# EAGLE board MCS (EAGLE 6.6.0) (continued)
## Tracks (layer width: path | path; a pad name or v marks a point on that pad's centre or on a via) (continued)
  pour Top: 63.27,23.88 62.41,23.88 62.36,23.93 62.36,24.66 62.46,24.77 63.22,24.77 63.27,24.71
+9V  (via drill 0.6)
  Top 0.406: R43.2 87.43,44.58 v87.83,44.98 | v73.74,52.63 73.74,52.07 73.23,51.56
  Top 1.016: C7.A 69.29,44.81 71.58,47.09 71.58,51.21 72.11,51.74 73.05,51.74 73.23,51.56
  Bottom 0.406: v87.83,44.98 87,44.98 86.59,45.39 74.73,45.39 73.89,46.23 73.89,52.48 v73.74,52.63
  pour Top: 72.26,58.45 72.26,51.21 76.71,51.18 76.71,58.8 72.9,58.8
  pour Top: 73.89,76.73 71.98,76.71 71.5,76.23 71.5,59.11 72.03,58.57 72.85,58.57 73.13,58.85 73.13,64.14 74.37,65.38 74.35,76.05
+12V
  Top 1.93: CASE2.30 52.48,84.05 U5.6
  Bottom 1.016: U5.5 53.77,79.45 C34.1 53.8,82.72 U5.6
+24V  (via drill 0.6)
  Top 0.305: v83.31,75.82 U8.EP
  Top 0.813: U5.2 53.82,60.48 53.82,59.16 52.73,58.06 37.52,58.06 35.92,59.66 K1.1
  Top 1.27: U5.2 55.32,60.53 58.42,63.63 58.42,97.41 62.74,101.73 97.66,101.73 99.44,99.95 99.44,95.63 98.43,94.61 96.7,94.61 CASE2.47
  Bottom 0.305: 22.96,68.22 22.96,69.95 23.11,70.1
  Bottom 0.813: D4.C 22.43,67.69 22.96,68.22 22.96,70.08 K3.1 | 23.11,70.1 24.89,70.1 25.91,71.12 25.91,73.41 27.05,74.55 37.34,74.55 38.1,73.79 38.1,64.9 37.59,64.39 37.59,60.83 37.21,60.45 36.14,60.45 K1.1
  Bottom 1.016: C33.1 51.21,60.58 U5.2
  Bottom 1.676: C35.1 54.08,60.83 U5.2
  other vias: 80.26,78.11 81.79,78.11 83.31,78.11 84.84,78.11 86.36,78.11 81.03,76.96 82.55,76.96 84.07,76.96 85.6,76.96 80.26,75.82 81.79,75.82 84.84,75.82 86.36,75.82 81.03,74.68 82.55,74.68 84.07,74.68 85.6,74.68 80.26,73.66 81.79,73.66 83.31,73.66 84.84,73.66 86.61,73.66
  pour Bottom: 79.63,77.22 79.63,82.68 81.66,84.71 92.46,84.71 94.23,86.49 94.23,95.5 95.38,96.65 100.46,96.65 100.97,96.14 100.97,84.2 99.06,82.3 96.14,82.3 93.34,79.5 87.88,79.5 87.38,78.99 87.38,73.53 86.87,73.03 80.26,73.03 79.76,73.53 79.76,77.09
-
  Top 1.016: L2.1 71.11,85.96 73.28,88.14 76.84,88.14 79.38,90.68 88.67,90.68 CASE2.42
A  (via drill 0.5, 0.6)
  Top 0.254: U6.11 29.26,77.52 28.78,77.04 28.78,74.35 28.14,73.71 26.29,73.71 25.15,72.57 25.15,60.2 24.64,59.74 24.64,57.63 23.57,56.57 23.57,44.78 25.4,42.95 38.05,42.95 v38.8,42.2 39.95,40.92 39.95,39.86 U1.37 | U1.37 | U8.6 85.34,69.93 84.05,68.63 83.59,68.63 82.85,67.89 82.17,67.89 v81.76,67.49 | v65.41,62.59 63.04,62.59 62.53,62.08 62.53,61.14 60.63,59.23 60.63,44.86 60.66,44.86 60.93,44.58 v61.54,44.58
  Bottom 0.254: v81.76,67.49 81.1,66.83 73.84,66.83 73.48,66.47 73.48,64.64 71.42,62.59 v65.41,62.59 | v61.54,44.58 60.48,44.58 59.06,43.15 39.78,43.15 v38.8,42.2
ASEN  (via drill 0.6)
  Top 0.254: 84.59,65.91 84.59,64.43 84.81,64.21 87.91,64.21 v87.93,64.24 | v60.07,25.93 60.07,34.01 v60.27,34.42 | v55.5,32.84 55.5,34.26 55.22,34.54 54.28,34.54 SJ3.3
  Top 0.305: C16.1 84.59,65.91 R14.2
  Bottom 0.254: v60.07,25.93 60.35,25.65 63.73,25.65 64.85,26.77 64.85,27.28 67.49,29.92 87.5,29.92 88.77,31.19 88.77,51.82 88.87,52.1 88.87,64.03 88.62,64.24 v87.93,64.24 | v60.27,34.42 55.8,34.42 55.37,33.98 55.37,32.97 v55.5,32.84
B  (via drill 0.5, 0.6)
  Top 0.254: U6.10 30.3,76.25 29.29,75.23 29.29,74.09 28.42,73.23 26.52,73.23 25.63,72.34 25.63,59.99 25.17,59.54 25.17,57.4 24.08,56.31 24.08,45.11 25.73,43.46 38.76,43.46 v40.25,41.92 40.64,41.5 40.64,40 U1.36 | U8.5 84.07,69.8 83.67,69.39 82.85,69.39 v82.32,68.86 | v69.75,63.53 69.62,63.45 62.56,63.45 62,62.89 62,61.37 60.15,59.51 60.15,43.76 v60.6,43.31
  Bottom 0.254: v82.32,68.86 81.74,68.86 80.34,67.46 73.25,67.46 73,67.21 73.03,65.56 71.04,63.58 69.85,63.58 v69.75,63.53 | v60.6,43.31 60.02,43.31 59.31,42.6 41.15,42.6 40.36,41.81 v40.25,41.92
BOX_TEMP  (via drill 0.6)
  Top 0.254: R8.1 NTC.2 | NTC.2 C14.1 | NTC.2 63.34,55.2 63.37,55.17 63.37,56.16 v63.78,56.57 | v64.41,50.85 64.39,31.65 63.27,30.53 63.27,27.15 v63.5,26.92 | v41.63,25.81 41.63,28.18 U1.21
  Bottom 0.254: v63.78,56.57 63.78,52.55 64.41,52.02 v64.41,50.85 | v63.5,26.92 42.75,26.92 v41.63,25.81
C  (via drill 0.5, 0.6)
  Top 0.254: U6.9 30.94,74.98 28.68,72.72 26.7,72.72 26.11,72.14 26.11,59.79 25.65,59.31 25.65,57.18 24.61,56.13 24.61,45.36 25.96,44.02 39.42,44.02 41.58,41.86 v41.58,41.35 U1.35 | U8.3 81.53,69.54 81.05,69.06 v80.44,69.06 | v68.76,64.36 61.93,64.36 61.52,63.98 61.52,61.57 59.66,59.72 59.66,42.47 v60.2,41.94
  Bottom 0.254: v80.44,69.06 80.44,68.71 79.73,68 72.87,68 72.39,67.51 72.39,65.73 70.87,64.36 v68.76,64.36 | v60.2,41.94 42.19,41.94 v41.58,41.35
DAC-EN  (via drill 0.5)
  Top 0.254: v39.98,30.91 U1.19 | U1.19
  Bottom 0.254: R2.2 13.1,51.86 12.37,51.13 12.37,47.09 13.39,46.08 21.29,46.08 22.2,45.16 22.2,41.33 24.08,39.45 39.32,39.45 39.93,38.84 39.93,38.43 39.95,31.06 v39.98,30.91
FAN
  Top 0.254: R21.2 78.75,84.34 78.87,84.45 80.39,84.45 80.47,84.54
  Top 2.54: 80.47,84.54 82.42,86.49 94.72,86.49 96.57,88.34 96.6,90.68 CASE2.48
  pour Top (no thermals): 78.49,79.76 82.8,79.76 83.19,80.14 83.19,82.93 84.07,83.82 94.74,83.82 96.27,85.34 96.27,86.61 95,87.88 80.64,87.88 78.49,85.73
FAN-PWM  (via drill 0.5, 0.6)
  Top 0.254: v78.82,68.96 78.82,70.87 U8.1 | v69.77,65.23 61.57,65.23 61.01,64.69 61.01,61.8 59.16,59.94 59.16,41.07 v59.92,40.31 | v37.08,41.55 36.93,41.55 36.78,41.4 U1.41 | U1.41
  Bottom 0.254: v69.77,65.23 70.97,65.23 71.86,66.01 71.86,68.25 72.16,68.55 78.38,68.55 78.82,68.94 78.77,68.91 v78.82,68.96 78.84,68.99 | v59.92,40.31 59.06,41.17 43.38,41.17 42.29,40.08 40.34,40.08 39.4,41.02 37.62,41.02 v37.08,41.55
GND  (via drill 0.5, 0.6)
  Top 0.254: C40.2 66.59,71.82 67.16,72.39 67.16,73.15 67.18,73.18
  Top 0.305: CASE2.9 12.93,90.7 16.92,94.69 16.92,94.97 18.69,96.75 18.9,96.75 20.42,98.27 20.45,98.27 20.83,98.65
  Top 0.406: CASE2.37 68.88,94.72 CASE2.35 64.92,90.73 CASE2.33 65,90.63 65.02,89.81 65.02,86.28 60.88,86.28
  Top 0.61: CASE2.3 4.93,87.66 6.99,85.6 13.59,85.6 | 13.59,85.6 13.84,85.34 | CASE2.15 20.78,90.73 | CASE2.9 12.85,90.73 | CASE2.7 12.85,98.65 | 13.59,85.6 13.59,85.37 13.56,85.34
  Top 0.813: CASE2.5 8.89,94.72 CASE2.7 16.81,94.72 | 16.81,94.72 CASE2.13 | CASE2.11 16.81,94.72 | 12.85,90.73 CASE2.11 | CASE2.11 16.81,94.67 CASE2.15 | 20.83,98.65 23.06,98.65 24.08,97.64 24.1,97.64 24.38,97.36 24.38,87.58 25.6,86.36 26.29,86.36
  Bottom 0.61: CASE2.43 91.77,98.68 90.7,97.61 90.7,87.1 89.46,85.85 88.27,85.85 87.76,85.34
  Bottom 0.813: CASE2.17 36.63,95.05 38.15,96.57 38.18,96.57 38.28,96.67 46.08,96.67 46.51,96.24 46.51,92.71 CASE2.27 49.63,89.59 49.63,86.13 50.06,85.7
  other vias: 13.72,1.27 88.27,1.14 30.94,85.6 35.56,84.56 40.13,85.37 42.11,85.42 26.16,75.44 32.54,70.15 18.64,82.35 17.6,85.37 14.02,82.73 17.09,71.07 21.31,71.3 14.02,66.07 40.44,74.68 40.77,66.83 54.81,85.45 51.33,82.09 42.11,53.47 75.39,63.91 76.94,63.88 75.36,60.3 76.83,60.33 80.77,51.18 82.3,51.18 83.69,51.18 85.09,51.18 81.66,49.28 80.64,47.12 82.04,47.12 83.44,47.12 85.22,47.24 83.06,49.28 84.45,49.28 69.6,77.72 69.6,85.6 69.47,82.55 13.46,53.72 18.67,57.53 20.7,61.85 13.97,60.45 66.12,77.47 65.74,84.71 65.74,81.38 27.66,50.6 29.92,61.39 32.61,65.51 29.84,69.32 29.84,63.86 40.82,38.13 29.92,59.49 36.3,38.15 34.72,30.4 39.04,32.49 37.08,56.72 38.13,59.39 70.1,69.14 64.77,72.39 27,45.67 51.69,47.12 51.79,51.89 49.35,59.64 48.67,77.62 51.66,71.98 75.46,74.22 75.95,49.4 70.66,34.24 67.54,40.87 60.66,36.6 27.64,33.45 21.49,38.33 26.39,41.1 65.25,25.7 67.08,48.84 60.99,83.72 53.34,40.49 53.9,32.54
  pour Bottom (rank 6): 13.08,86.36 88.9,86.36 88.9,0.38 12.7,0.38
  pour Top (rank 6): 12.7,86.36 88.9,86.36 88.9,0.38 12.7,0.38
INC
  Top 0.254: U1.14 35.89,28.15 35.89,24.54 36.73,23.7 56.01,23.7 58.17,25.86 58.17,60.45 59.92,62.2 59.92,68.58 60.58,69.24 U11.1
MC1-B  (via drill 0.6)
  Top 0.254: v44.37,46.38 44.37,39.42 44.78,39.01 45.57,39.01 45.85,38.73 45.85,37.59 45.47,37.21 44.2,37.21 U1.32
  Bottom 0.254: RN2.3 44.2,46.81 v44.37,46.38
MC1-F  (via drill 0.6)
  Top 0.254: v45.95,49.89 45.95,49.48 47.35,48.34 v47.35,39.29 | U1.26 45.31,32.44 45.64,32.13 v47.12,32.13
  Bottom 0.254: RN2.1 45.8,50.03 v45.95,49.89 | v47.35,39.29 47.32,32.36 v47.12,32.13
MC1-PE  (via drill 0.6)
  Top 0.254: v42.9,45.69 43.26,45.69 43.87,44.96 43.87,38.1 U1.33
  Bottom 0.254: RN2.4 43.4,46.2 v42.9,45.69
MC1-R  (via drill 0.6)
  Top 0.254: 45.29,47.95 v45.26,47.95 45.26,47.83 46.02,47.37 46.02,40.36 v45.97,40.26 | U1.27 v45.95,33.24 46.19,33.24 45.97,33.22
  Bottom 0.254: RN2.2 45,48.22 v45.26,47.95 | v45.97,40.26 45.97,34.38 v45.95,33.24
MC1-RE  (via drill 0.6)
  Top 0.254: v42.24,56.18 43.03,55.4 43.03,47.95 41.61,46.53 41.61,44.37 42.49,43.48 42.49,39.95 U1.34
  Bottom 0.254: v42.24,56.18 42.24,58.34 43.18,59.28 43.18,69.81 R17.1
MC-1-B
  Top 0.305: TP4.P$1 16.13,84.58 17.15,83.57 17.15,75.56 16.76,75.18 K3.8
  Bottom 0.305: TP4.P$1 15.49,86.11 14.61,86.99 8.05,86.99 6.71,88.29 6.71,94.01 6.02,94.74 4.98,94.74 CASE2.2
MC-1-T
  Top 0.305: CASE2.1 6.17,98.68 6.68,98.17 6.68,88.21 8.08,86.82 18.54,86.87 19.43,86.23 TP5.P$1 19.43,83.69 20.96,82.17 20.96,75.69 21.34,75.18 K3.3
MC-PG-EN  (via drill 0.6)
  Top 0.254: CASE2.28 55.09,98.68 56.49,97.28 56.49,64.29 54.56,62.36 39.5,62.36 v39.07,62.79 | R31.1 27.35,48.3 v27.74,48.69
  Bottom 0.254: v27.74,48.69 31.27,48.69 33.05,46.91 34.77,46.91 35.05,47.19 35.05,49.81 35.81,50.57 38.43,50.57 39.09,51.23 39.09,62.76 v39.07,62.79
MCRX
  Top 0.254: U14.4 33.85,53.17 | 33.85,53.17 34.06,52.96 34.06,48.72 34.21,48.56 36.24,48.56 RX.C | 33.85,53.17 33.85,61.1 34.19,61.44 37.24,61.44 37.47,61.67 37.47,65.13 37.21,65.38 35.99,65.38 K1.3
MCTX  (via drill 0.6)
  Top 0.254: U14.5 33.31,52.54 33.5,52.27 33.5,48.08 | TX.C 36.47,46.86 34.24,46.86 33.5,47.6 33.5,48.08 | 28.32,65.33 K1.8 30.56,65.3 v32.56,63.3 | v33.22,48.16 33.43,48.16 33.5,48.08
  Bottom 0.254: v32.56,63.3 32.56,62.66 33.1,62.13 33.1,48.51 33.2,48.21 v33.22,48.16
N$1  (via drill 0.6)
  Top 0.254: C22.1 15.52,38.51 JP9.1 15.93,38
  Top 0.305: S2.3 26.04,30.07 25.45,30.66 20.9,30.66 v20.52,30.28
  Top 0.406: SJ1.2 27.41,24.21 26.64,24.97 26.64,26.7 S2.3
  Bottom 0.254: R40.1 15.97,37.96 JP9.1
  Bottom 0.305: v20.52,30.28 20.52,37.41 19.99,37.95 R40.1
  Bottom 0.406: R41.1 28.98,22.53 26.64,24.87 26.64,26.7 S2.3
N$2  (via drill 0.5)
  Top 0.406: v38.15,30.68 38.3,30.23 38.33,30.2 38.33,28.29 U1.17
  Bottom 0.406: L3.1 C21.1 35.73,31.36 36.14,30.94 37.9,30.94 v38.15,30.68
N$3  (via drill 0.6)
  Top 0.406: v18.36,76.23 18.36,66.42 17.53,65.58 16.36,65.58 | 16.36,65.58 U7.2 | 16.36,65.58 16.29,65.58 U7.1
  Bottom 0.406: K3.7 17.52,77.72 R1.1 17.89,77.59 18.03,77.44 18.03,76.56 v18.36,76.23
N$4  (via drill 0.6)
  Top 0.254: v29.36,33.48 29.39,33.48 29.64,33.22 32.57,33.22 U1.7
  Bottom 0.254: C8.A 32.66,33.32 U1.7 29.6,33.24 v29.36,33.48
N$5
  Top 0.254: U1.22 43.97,28.24 R39.2
N$6
  Top 0.406: R43.1 +9V.A
N$7  (via drill 0.6)
  Top 0.254: v46.81,63.45 42.16,63.45 v41.81,63.8
  Bottom 0.254: RN2.8 45.8,57.41 46.48,58.09 46.48,63.12 v46.81,63.45 | v41.81,63.8 41.81,79.15 40.49,80.47 39.42,80.47 38.56,81.33 38.56,82.81 Q3.1
N$8  (via drill 0.6)
  Top 0.254: 39.14,28.2 U1.18 39.17,26.37 v39.07,25.93
  Bottom 0.254: R41.2 38.46,22.53 39.09,23.16 39.07,25.76 v39.07,25.93
N$9
  Bottom 0.813: Q3.3 37.57,89.69 CASE2.18
N$10
  Top 0.406: U9.1 30.07,23.57 SJ1.1
N$11
  Top 0.254: TX2.A R15.1
N$12
  Top 0.254: U1.8 19.43,32.44 17.81,30.81 15.24,30.81 JP9.4
N$13
  Top 0.254: U15.7 24.7,17.23 24.51,17.42 23.75,17.42 23.5,17.68 23.5,18.66 TX2.C
N$14
  Top 0.254: U15.14 27.24,8.44 RX2.C
N$15
  Top 0.254: U1.9 19.72,31.64 17.93,29.84 17.93,28.55 17.68,28.3 JP9.5
N$16
  Top 0.254: RX2.A R16.1
N$17
  Top 0.305: U16.1 21.65,61.67 | 21.65,61.67 21.65,63.72 U7.5 | TP3.P$1 21.65,61.67
N$18  (via drill 0.6)
  Top 0.406: v19.91,76.35 19.91,67.67 20.52,67.06 22.96,67.06 23.29,66.73 23.29,65.46 23.04,65.2 21.87,65.2 U7.7 U7.6
  Bottom 0.406: K3.4 20.2,77.72 R7.1 20.07,76.5 v19.91,76.35
N$19  (via drill 0.6)
  Top 0.254: U4.2 30.53,13.18 30.1,13.61 30.1,15.65 v30.35,15.9 | v26.29,17.55 26.54,17.3 26.54,16.07 U15.4
  Bottom 0.254: v30.35,15.9 26.71,15.9 U15.4 26.61,17.11 v26.29,17.55
N$20
  Bottom 0.254: RN2.7 45,57.83 45.62,58.45 45.62,64.82 46.69,65.89 46.69,68.83 46.94,69.09 46.94,74.27 47.5,74.83 47.5,76.91 46.66,77.75 45.74,77.75 Q5.1
N$21
  Bottom 0.305: K3.9 15.41,72.68 R3.1 22.95,72.68 K3.2
N$22
  Top 0.305: U17.1 17.46,62.18 | 17.46,62.18 17.46,64.2 17.09,64.57 U7.3 | TP8.P$1 17.43,62.33 17.46,62.18
N$23
  Top 0.254: LED2.A R21.1
N$24
  Top 0.254: U11.5 64.39,77.75 U10.3
N$25
  Top 0.406: R24.1 82.4,36.64 +3V.A
N$26  (via drill 0.6)
  Top 0.813: v46.58,80.39 44.75,80.39 44.42,80.72 44.42,87.22 42.57,89.08 42.57,98.04 41.91,98.7 40.61,98.7 CASE2.19
  Bottom 0.813: Q5.3 46.03,79.84 v46.58,80.39
N$27
  Top 0.254: U4.3 29.16,12.52 28.58,13.11 28.58,15.94 U15.1
N$28
  Top 0.254: U15.9 22.33,10.72 21.97,11.07 21.97,11.95 R52.2
N$29  (via drill 0.6)
  Top 0.254: v50.09,84.51 50.09,67.69 49.05,66.65 45.62,66.65 v45.34,66.37
  Bottom 0.254: RN2.6 44.2,57.92 44.96,58.67 44.96,65.99 v45.34,66.37 | Q6.1 49.34,83.75 v50.09,84.51
N$30
  Bottom 0.813: Q6.3 48.39,87.66 47.55,88.49 43.15,88.49 42.57,89.08 42.57,93.83 41.63,94.72 40.61,94.72 CASE2.20
N$31
  Top 0.254: TX1.A R18.1
N$32
  Top 0.254: RX1.A R5.1
N$33
  Top 0.254: U1.25 45.2,31.64 45.75,31.09 52.25,31.09 52.63,31.47 52.63,35.64 52.96,35.97 54.18,35.97 SJ3.2
N$35
  Bottom 0.254: R17.2 45.68,72.46 Q8.1
N$37
  Top 0.254: R39.1 LED7.A
N$39
  Top 0.254: U1.31 50.23,36.44 50.06,36.65 49.38,37.53 Y1.3 49.12,40.39 C24.1
N$40
  Top 0.254: C23.1 51.44,32.69 Y1.1 50.18,35.92 48.18,35.92 47.9,35.64 U1.30
N$41
  Top 0.406: R19.2 +5V.A
N$42
  Bottom 0.254: Q1.1 15.68,55.55 R4.2 15.63,53.69 R2.1
N$43
  Bottom 0.813: D4.A 16.05,67.69 15.29,68.45 15.29,70.03 K3.10 15.24,69.98 12.57,69.98 11.68,69.09 11.68,60.32 12.74,59.27 Q1.3
N$45
  Top 0.305: U8.7 86.61,69.34 86.11,68.83 86.11,67.7 R13.2 R14.1
N$54
  Top 0.254: U15.8 22.83,16 22.48,15.65 22.48,15 R53.2
N$55
  Top 0.406: R52.1 16.76,12.09 JP13.3
  Bottom 0.406: C11.1 16.76,12.09 JP13.3
N$59
  Top 0.254: C10.1 32.06,55.54 U14.1
N$61
  Top 0.406: R53.1 JP13.2
  Bottom 0.406: C13.1 JP13.2
N$62
  Top 0.254: SJ2.2 28.92,10.31 U15.16
N$63
  pour Top (no thermals): 74.12,78.74 71.02,78.74 70.74,79.02 70.74,81.99 71.07,82.32 73.96,82.32 74.12,82.17
N$65
  Top 0.254: U14.2 31.74,54.44 31.29,54 30.77,54 C10.2
N$66
  Top 0.254: U14.16 37.8,55.91 38.2,56.31 39.79,56.31 C12.1
N$67
  Top 0.254: U14.15 39.62,54.44 C12.2
N$68
  Top 0.254: U14.7 C15.1
N$69
  Top 0.254: R29.1 39.02,13.62 38.56,13.16 36.9,13.16 U4.7
N$70
  Bottom 0.813: Q7.3 44.58,86.03 43.69,86.92 41.68,86.92 40.64,87.96 40.64,90.65 CASE2.21
N$71  (via drill 0.6)
  Top 0.813: v46.38,75.29 46.38,78.05 47.65,79.32 47.65,79.35 47.98,79.68 47.98,87.38 46.48,88.87 46.48,97.92 45.72,98.68 CASE2.22
  Bottom 0.813: Q8.3 45.8,74.71 v46.38,75.29
N$72
  Top 0.254: U14.10 38.72,51.27 39.29,50.7 40.4,50.7 C17.2
N$73  (via drill 0.6)
  Top 0.254: v31.8,90.42 31.8,90.4 31.19,89.79 31.19,87.91 33.58,85.52 36.25,85.52 36.58,85.19 36.58,74.09 36.09,73.61 34.87,73.61 33.76,72.49 v33.76,72.36 | v35.26,51.99 35.26,52.15 35.64,52.53 37.78,52.53 U14.12
  Bottom 0.254: CASE2.40 87.43,98.68 84.63,101.47 34.44,101.47 32.51,99.54 32.51,91.13 v31.8,90.42 | v35.26,51.99 35.08,52.17 35.08,57.51 33.93,58.65 33.93,72.19 v33.76,72.36
N$74  (via drill 0.6)
  Top 0.254: v32.66,88.39 32.82,88.39 35.18,86.03 36.96,86.03 37.26,85.72 37.26,73.86 35.74,72.34 v35.23,72.34 | v36.09,53.54 36.45,53.19 37.78,53.19 U14.13
  Bottom 0.254: CASE2.41 86.92,94.69 85.62,95.99 85.62,99.52 84.23,100.91 34.8,100.91 33.12,99.24 33.12,88.85 v32.66,88.39 | v36.09,53.54 35.74,53.9 35.74,57.68 34.47,58.95 34.47,71.58 v35.23,72.34
N$75  (via drill 0.6)
  Top 0.254: v40.31,48.62 38.64,48.62 RX.A
  Bottom 0.254: R27.1 40.23,48.69 v40.31,48.62
N$76  (via drill 0.6)
  Top 0.254: v40.41,46.71 38.72,46.71 TX.A
  Bottom 0.254: R28.1 40.16,46.71 v40.41,46.71
N$77
  Top 1.016: K1.10 28.3,59.94 26.82,58.47 26.82,56.32 Q9.3
N$78
  Top 0.406: Q9.1 25.82,52.5 R30.1 25.77,50.44 R31.2
N$79
  Bottom 0.305: R20.2 53.09,73.91 U5.4
N$80
  Bottom 0.254: Q10.3 53.72,70 U5.3
N$81  (via drill 0.6)
  Top 0.254: v44.09,67.41 43.28,67.41 42.16,68.53 42.16,80.16 v42.85,80.85
  Bottom 0.254: RN2.5 43.4,58.26 44.2,59.05 44.2,67.31 v44.09,67.41 | v42.85,80.85 43.21,81.2 45.16,81.2 45.54,81.58 45.54,82.68 Q7.1
N$82
  Bottom 0.254: R22.2 48.56,68.99 Q10.1
N$85
  Top 0.254: 16.51,9.55 JP13.4 | C6.1 C3.A
  Top 0.305: 16.51,9.55 25.63,9.55 25.96,9.88 25.96,10.71 U15.12
  Top 0.406: C3.A 15.11,8.66 JP13.4
OUT
  Top 0.254: U6.5 25.93,78.79 25.15,78.13 25.15,73.3 24.66,72.82 24.66,60.43 24.1,59.94 24.1,57.86 23.04,56.79 23.04,44.53 25.1,42.47 37.41,42.47 39.14,40.54 U1.38
OUT-RX
  Top 0.254: CASE2.26 49.45,94.69 50.44,95.68 50.44,99.82 48.31,101.96 35.71,101.96 33.27,99.52 33.27,89.1 35.71,86.66 37.41,86.66 37.82,86.26 37.82,68.3 37.34,67.82 35.94,67.82 K1.4
OUT-TX
  Top 0.254: CASE2.25 48.51,100 47.42,101.09 35.86,101.09 34.26,99.49 34.26,89.15 35.84,87.58 37.87,87.58 38.35,87.1 38.35,67.36 37.54,66.55 29.59,66.55 K1.7
PUMP_OUTPUT_CONTROL
  Top 0.406: CASE2.31 64.9,98.7 62.87,98.7 59.79,95.63 59.79,85.93 60.1,85.62 63.65,85.62 64.02,85.26 R6.2 C9.1 64.07,82.63 U10.4 64.08,80.66 64.08,79.78 63.91,79.6 62.59,79.6 62.17,79.19 U10.1
RS-A  (via drill 0.6)
  Top 0.254: U2.6 69.11,68.55 68.45,69.21 68.45,86.11 v69.34,86.99
  Bottom 0.254: v69.34,86.99 69.85,86.99 70.87,88.01 70.87,92.71 CASE2.38 73.6,93.94 R32.1
RS-B
  Top 0.254: U2.7 67.84,87.66 68.58,88.39 71.5,88.39 72.77,89.66 72.77,90.63 CASE2.39
  Bottom 0.254: R32.2 74.08,91.94 CASE2.39
RX2  (via drill 0.5, 0.6)
  Top 0.254: K1.2 34.39,62.76 32.64,61.01 32.64,57.81 31.83,57 29.74,57 29.39,56.64 29.39,46.35 30.3,45.49 31.37,45.49 v31.57,45.29 | U1.42 35.98,41.21 v35.74,41.45
  Bottom 0.254: v31.57,45.29 31.6,42.14 32.11,41.63 35.51,41.63 v35.74,41.45
RX3  (via drill 0.6)
  Top 0.254: v38.63,9.85 38.63,12.06 38.15,12.55 36.9,12.55 U4.6 | U1.4 24.69,35.64 v24.23,35.18
  Bottom 0.254: v38.63,9.85 38.13,9.35 36.09,9.35 35.59,9.85 35.59,18.8 34.19,20.19 24.1,20.19 22.76,21.54 22.76,33.81 v24.23,35.18
RXD1  (via drill 0.6)
  Top 0.254: RX1.C 66.55,59.82 | 66.55,59.82 66.55,61.75 U2.1 | 66.55,59.82 66.34,59.82 65.38,58.85 65.38,30.76 64.34,29.72 64.34,28.63 66.62,26.34 67.06,25.88 v67.06,25.6 | U1.2 24.33,37.24 24,37.44 22.94,37.44 22.53,37.06 22.53,35.51 v22.81,35.23
  Bottom 0.254: v67.06,25.6 67.06,22.91 66.29,22.15 41.61,22.15 40.26,20.8 40.26,8.97 39.29,8 34.85,8 33.96,8.89 33.96,18.59 33.22,19.33 23.5,19.33 22.17,20.65 22.17,34.87 22.53,35.23 v22.81,35.23
SCL
  Top 0.254: Q2.2 21.02,47.17 | 21.02,47.17 R9.1 | 21.02,47.17 21.02,43.12 24.38,39.75 34.29,39.75 U1.44
SCL_5V  (via drill 0.5)
  Top 0.254: R11.1 18.02,52.95 v17.78,52.7 | U17.5 16.51,56.13 17.02,55.75 v17.78,55.75 20.32,55.75 20.7,56.13 U16.5
  Top 0.406: Q2.3 R11.1
  Bottom 0.254: v17.78,52.7 v17.78,55.75
SDA
  Top 0.254: Q4.2 16.7,47.17 | 16.7,47.17 R10.1 | 16.7,47.17 16.69,46 17.08,45.66 18.48,45.66 19.56,44.58 19.56,43.18 24.64,37.97 32.64,37.97 U1.1
SDA_5V
  Top 0.254: U17.4 15.56,58.36 15.88,58.67 19.43,58.67 19.69,58.42 19.69,57.62 U16.4 | 15.54,57.53 14.86,57.53 14.48,57.15 14.48,53.47 14.99,52.96 R12.1
  Top 0.406: Q4.3 R12.1 | 15.54,57.53 U17.4 | U16.4 19.75,57.34 19.69,57.28
SP1  (via drill 0.6)
  Top 0.305: U6.4 25.4,80.06 | 25.4,80.06 24.77,80.7 24.77,82.96 23.75,83.97 22.15,83.97 21.54,84.58 21.54,86.18 20.09,87.63 9.02,87.63 7.21,89.43 7.21,97.13 CASE2.4 | v25.58,79.76 25.58,79.88 25.4,80.06
  Bottom 0.305: RN3.1 27.25,79.76 26.95,80.06 25.88,80.06 v25.58,79.76
SP2  (via drill 0.6)
  Top 0.305: CASE2.6 8.89,89.15 9.65,88.39 20.47,88.39 22.3,86.56 22.3,84.91 22.58,84.63 24.03,84.63 25.4,83.26 25.4,81.58 25.7,81.28 v25.88,81.28 27.45,81.28 U6.3
  Bottom 0.305: RN3.2 28.05,80.78 U6.3 25.93,81.33 v25.88,81.28
SP3  (via drill 0.6)
  Top 0.305: v28.96,82.63 27.53,82.63 U6.2
  Bottom 0.305: CASE2.8 11.23,94.69 10.85,94.31 10.85,88.26 11.2,87.91 21.31,87.91 22.43,86.79 22.43,84.23 23.06,83.59 24.87,83.59 25.98,82.47 28.8,82.47 v28.96,82.63 28.85,82.52 RN3.3
SP4  (via drill 0.6)
  Top 0.305: v26.04,84.12 26.06,84.12 26.31,83.87 U6.1 27.55,83.92 29.49,83.92 29.9,83.51 v29.9,79.93
  Bottom 0.305: CASE2.10 15.27,98.68 14.83,98.25 14.83,89.41 15.37,88.87 21.44,88.87 23.16,87.15 23.16,84.68 23.6,84.25 25.91,84.25 v26.04,84.12 | RN3.4 29.65,79.69 v29.9,79.93
SP5  (via drill 0.6)
  Top 0.305: v31.55,82.52 33.03,82.52 U6.15
  Bottom 0.305: CASE2.12 16.81,90.83 18.75,92.76 22.12,92.76 22.96,91.92 22.96,88.67 24.18,87.45 24.18,85.65 24.56,85.27 29.16,85.27 30.12,84.3 30.12,83.16 30.76,82.52 v31.55,82.52 31.08,82.06 RN4.1
SP6  (via drill 0.6)
  Top 0.305: CASE2.14 20.83,94.69 23.06,92.46 23.06,86.46 23.95,85.57 29.24,85.57 30.51,84.33 30.51,81.79 30.89,81.38 33.05,81.38 U6.14 33.13,81.31 v34.59,81.31
  Bottom 0.305: RN4.2 31.88,81.18 32.08,81.38 34.39,81.38 v34.59,81.31
SP7  (via drill 0.6)
  Top 0.305: v34.62,79.96 33.25,79.96 U6.13
  Bottom 0.254: CASE2.16 34.98,98.68 34.09,97.79 34.09,84.38 35.56,82.91 35.56,80.11 35.36,79.91 34.67,79.91 v34.62,79.96
  Bottom 0.305: RN4.3 32.68,79.64 U6.13 34.57,80.06 v34.62,79.96
TEMP1  (via drill 0.6)
  Top 0.254: RN1.8 48.93,55.02 50.47,55.02 51.03,55.57 v51.03,56.16 51.31,56.44 54.79,56.44 57.02,54.2 57.02,31.04 56.02,30.04 U1.23
  Bottom 0.254: v51.03,56.16 51.16,56.29 54.64,56.29 57.48,59.13 57.48,90.73 61.42,94.67 64.9,94.67 CASE2.32
TEMP2  (via drill 0.6)
  Top 0.254: RN1.7 48.94,54.23 51.51,54.23 51.84,54.56 v51.84,54.66 52.15,54.97 54.46,54.97 56.44,52.98 56.44,31.29 55.73,30.58 45.54,30.58 45.29,30.84 U1.24
  Bottom 0.254: v51.84,54.66 54.15,54.66 58.55,59.05 58.57,59.21 58.57,90.07 61.19,92.56 66.17,92.56 66.95,93.34 66.95,96.75 CASE2.34
TEMP3  (via drill 0.6)
  Top 0.254: RN1.6 49.06,53.39 v54.2,53.39 55.83,51.76 55.83,39.95 54.28,38.4 54.28,37.59 SJ3.1
  Bottom 0.254: v54.2,53.39 60.02,59.16 60.02,86.41 61.47,87.86 61.49,87.86 61.93,88.29 68.15,88.29 68.86,89 68.86,90.68 CASE2.36
TX2  (via drill 0.6)
  Top 0.254: K1.9 30.63,62.76 32.08,61.32 32.08,58.09 31.6,57.61 29.57,57.61 28.85,56.9 28.85,45.47 v29.13,45.19 | U1.43 35.18,40.74 34.62,41.3 31.57,41.3 v31.19,40.92
  Bottom 0.254: v29.13,45.19 30.18,45.19 30.71,44.65 30.71,41.4 v31.19,40.92
TX3  (via drill 0.6)
  Top 0.254: v36.88,10.69 36.88,11.87 U4.5 | U1.5 25.26,34.84 v23.85,33.45
  Bottom 0.254: v36.88,10.69 36.4,10.69 36.12,10.97 36.12,19.02 34.42,20.73 24.49,20.73 23.24,21.97 23.24,32.87 23.6,33.22 v23.85,33.45
TXD1  (via drill 0.6)
  Top 0.254: U2.4 70.36,61.75 70.36,59.94 69.7,59.28 TX1.C 70.65,59.09 70.92,58.83 70.92,51.99 70.51,51.59 70.51,47.5 69.11,46.1 66.8,46.1 66.5,45.8 66.5,28.47 68.68,26.29 v68.68,25.88 | v23.62,36.52 23.75,36.4 32.54,36.4 U1.3
  Bottom 0.254: v68.68,25.88 68.68,23.19 67.01,21.51 42.01,21.51 40.94,20.45 40.94,8.74 39.5,7.29 34.7,7.29 33.32,8.66 33.32,18.31 32.84,18.8 23.16,18.8 21.69,20.27 21.69,35.48 22.71,36.5 23.6,36.5 v23.62,36.52
U5-RE/DE  (via drill 0.6)
  Top 0.254: U2.3 U2.2 68.4,61.77 68.45,61.72 68.45,54.36 68.2,54.1 66.37,54.1 65.86,53.59 65.86,29.97 v65.25,29.24 | v32.64,28.19 32.64,29.98 U1.11
  Bottom 0.254: v65.25,29.24 33.66,29.21 v32.64,28.19
UP/!DN
  Top 0.254: U11.2 61.85,69.04 60.43,67.61 60.43,62 58.65,60.22 58.65,25.6 56.24,23.19 36.47,23.19 35.26,24.41 35.26,28.16 U1.13
WDI
  Top 0.254: U1.10 31.45,30.84 30.81,30.2 30.81,28.02 31.67,27.15 32.77,27.15 32.94,26.97 32.94,26.26 U9.4

## Text on the board
Top: RJ
tPlace: D2
tNames: +5v
_tsilk: R6 | R21 | L2 | K3 | U6 | U5 | L1 | C9 | + | C1 | D2 | V1 | U10 | LED2 | D1 | K1 | C40 | C20 | U11 | U8 | R13 | U7 | C29 | C80 | C16 | U2 | R14 | U17 | RX1 | R12 | R8 | Q9 | U14 | C14 | TX1 | U12 | U16 | R11 | RN1 | C12 | IC1 | R30 | C10 | NTC | R5 | R18 | Q4 | Q2 | C17 | R31 | C15 | RX | R10 | R9 | TX | C7 | R24 | R19 | R43 | C22 | C24 | C32 | +5v | U1 | + | + | Y1 | +3V | +5V | +9V | C23 | + | SJ1 | R39 | S2 | U9 | LED7 | JP9 | TX2 | R15 | "MCS" / Motor Control System | R29 | R53 | U15 | SJ2 | R52 | C6 | R16 | RX2 | C3
_bsilk: R32 | Q3 | Q7 | Q6 | R1 | R7 | C34 | Q5 | R20 | RN4 | RN3 | R3 | Q8 | Q10 | R17 | D4 | C4 | C35 | C33 | C5 | R22 | Q1 | R4 | RN2 | R27 | R2 | R28 | C19 | C8 | R40 | L3 | C18 | C21 | R41 | C13 | C2 | C11